# EasyEDA Pro project Athena.eprj, schematic Schematic, sheet 2 of 4

## Sheets
2 Power: Page Name: Power
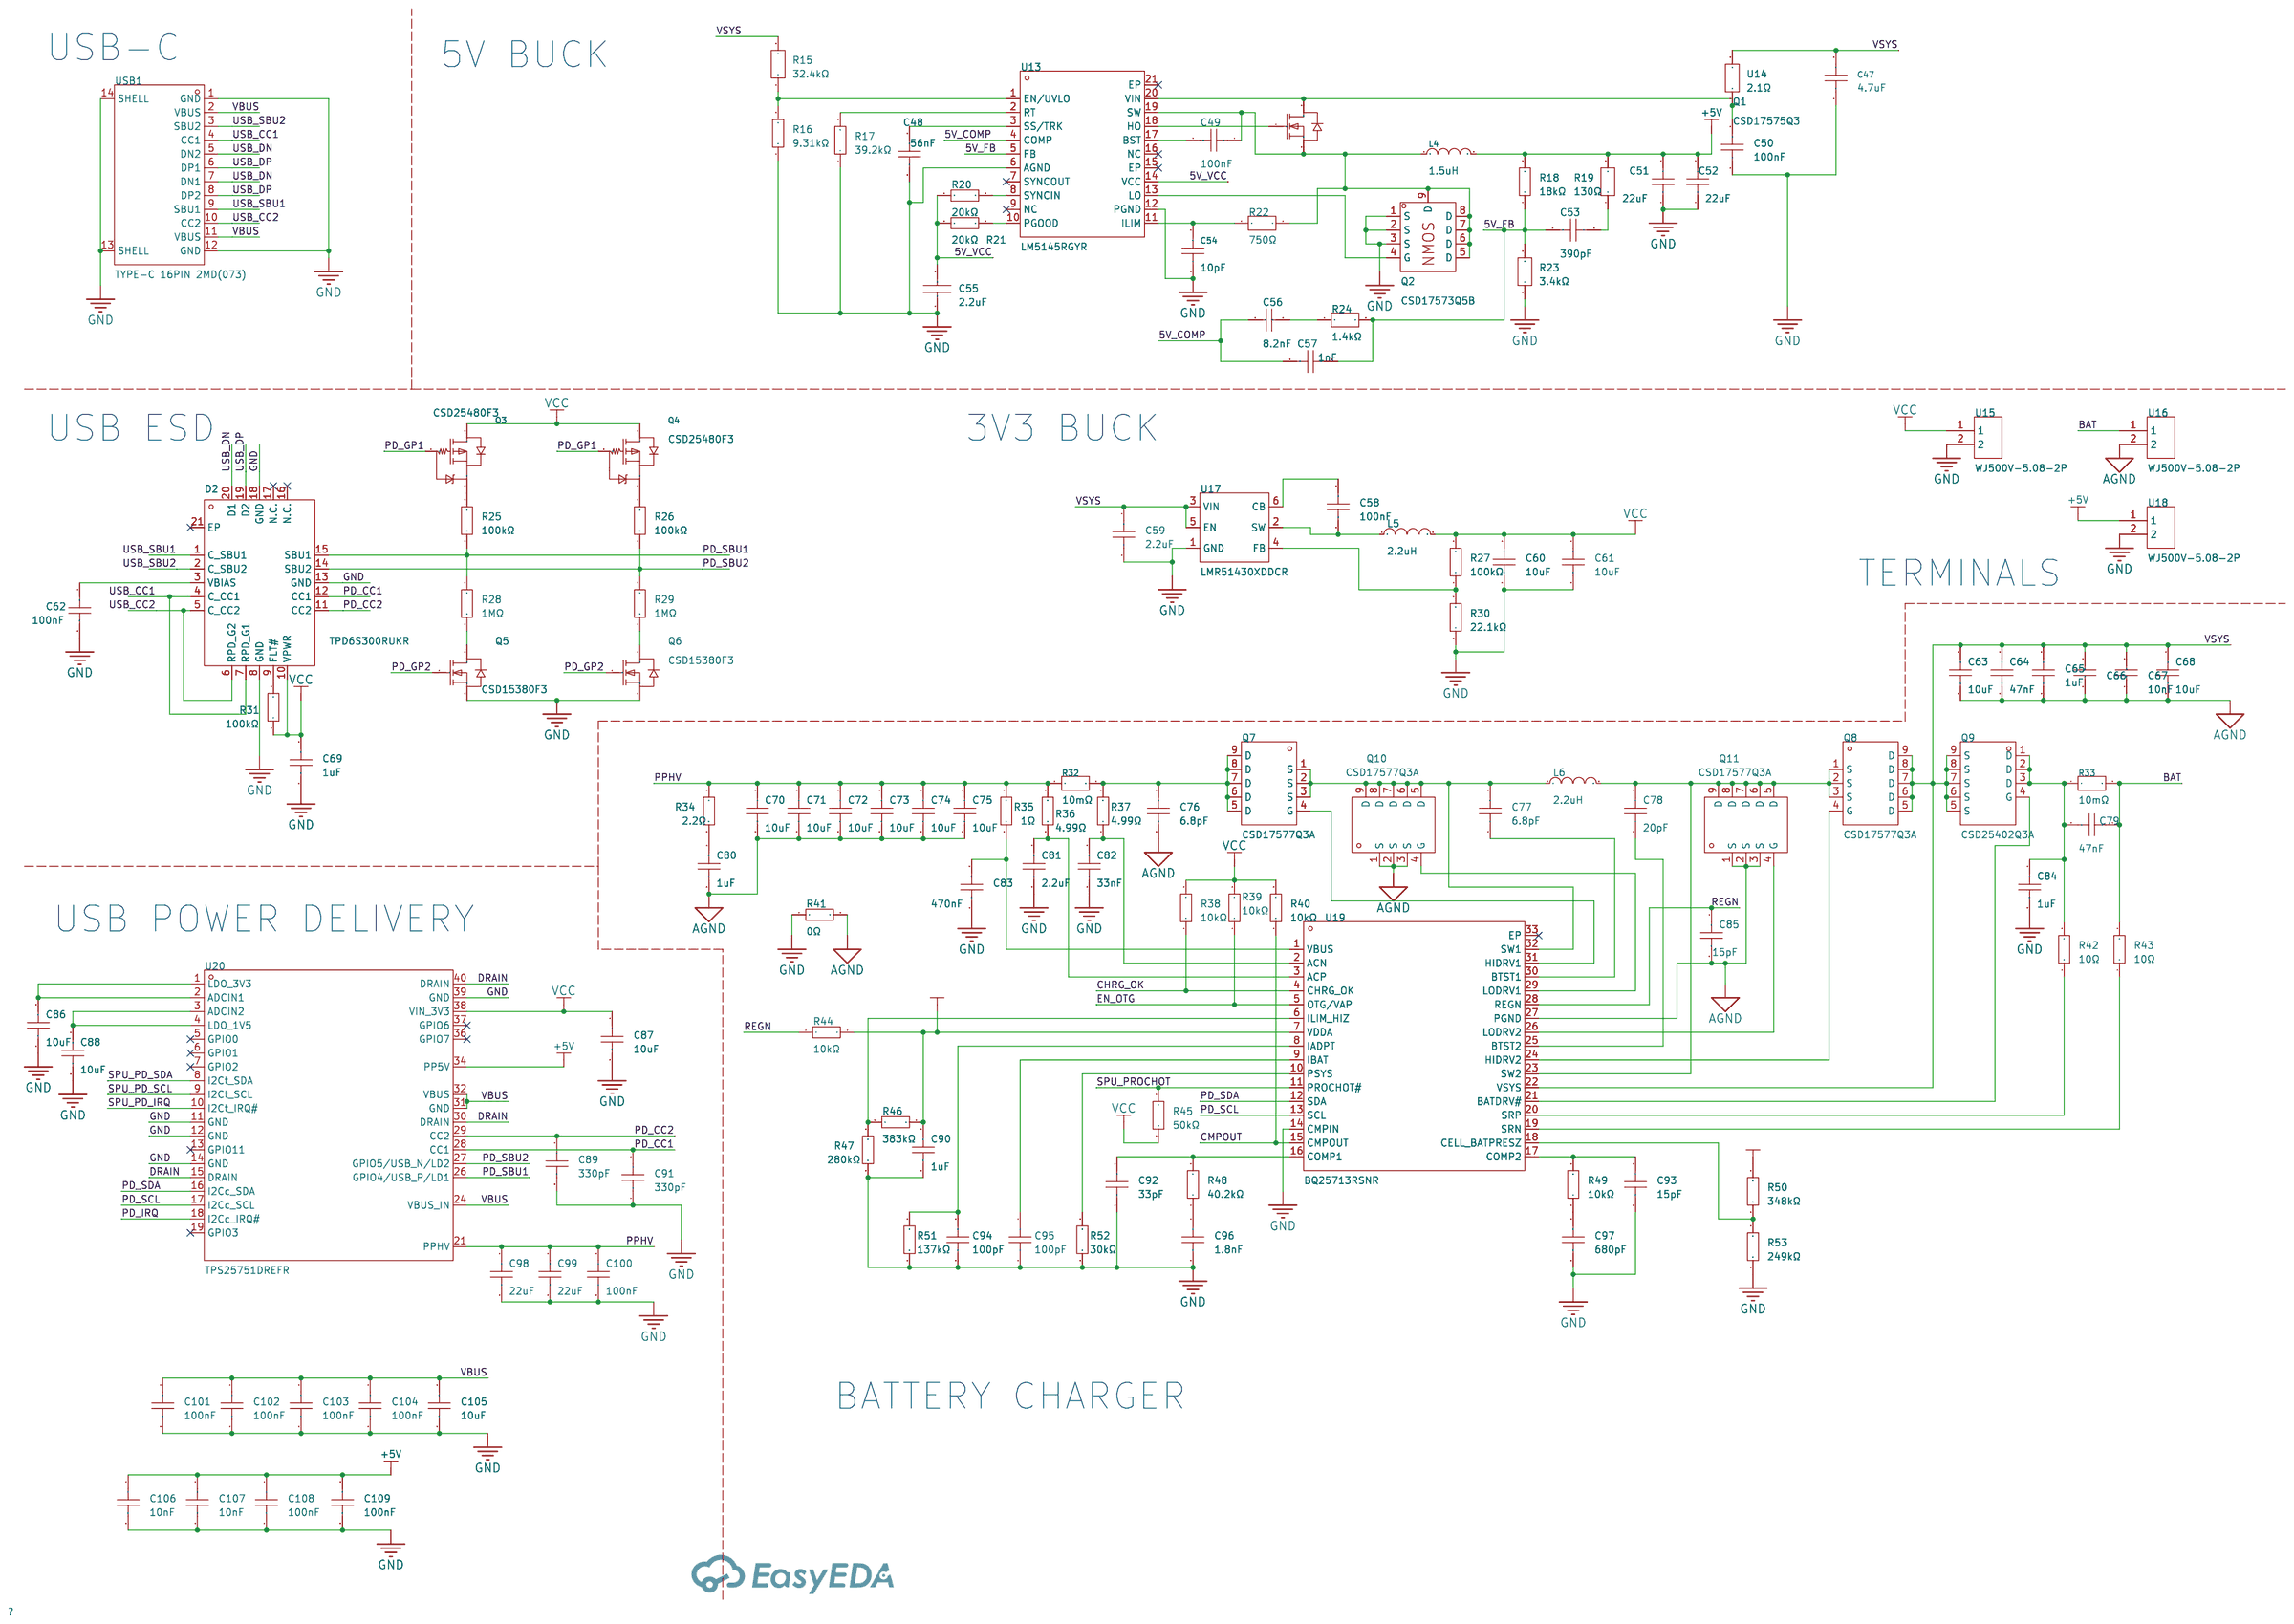
[diagram p1: Power]

## Parts
C47  4.7uF  [C1210]
C48  56nF  [C0603]
C49  100nF  [C0603]
C50  100nF  [C0603]
C51  22uF  [C0805]
C52  22uF  [C0805]
C53  390pF  [C0402]
C54  10pF  [C0603]
C55  2.2uF  [C0402]
C56  8.2nF  [C0402]
C57  1nF  [C0402]
C58  100nF  [C0402]
C59  2.2uF  [C0805]
C60  10uF  [C0603]
C61  10uF  [C0603]
C62  100nF  [C0402]
C63  10uF  [C0805]
C64  47nF  [C0805]
C65  1uF  [C0805]
C66  100pF  [C0805]
C67  10nF  [C0805]
C68  10uF  [C0805]
C69  1uF  [C0402]
C70  10uF  [C0805]
C71  10uF  [C0805]
C72  10uF  [C0805]
C73  10uF  [C0805]
C74  10uF  [C0805]
C75  10uF  [C0805]
C76  6.8pF  [C0603]
C77  6.8pF  [C0603]
C78  20pF  [C0603]
C79  47nF  [C0402]
C80  1uF  [C0402]
C81  2.2uF  [C0603]
C82  33nF  [C0603]
C83  470nF  [C0603]
C84  1uF  [C0402]
C85  15pF  [C0402]
C86  10uF  [C0402]
C87  10uF  [C0402]
C88  10uF  [C0402]
C89  330pF  [C0402]
C90  1uF  [C0402]
C91  330pF  [C0402]
C92  33pF  [C0402]
C93  15pF  [C0402]
C94  100pF  [C0402]
C95  100pF  [C0402]
C96  1.8nF  [C0402]
C97  680pF  [C0402]
C98  22uF  [C0805]
C99  22uF  [C0805]
C100  100nF  [C0402]
C101  100nF  [C0402]
C102  100nF  [C0402]
C103  100nF  [C0402]
C104  100nF  [C0402]
C105  10uF  [C0805]
C106  10nF  [C0402]
C107  10nF  [C0402]
C108  100nF  [C0805]
C109  100nF  [C0805]
D2  TPD6S300RUKR  [WQFN-20_L3.0-W3.0-P0.40-BL-EP1.7]
L4  1.5uH  [IND-SMD_L11.5-W10.0_104CDMCCDS]
L5  2.2uH  [L1206]
L6  2.2uH  [IND-SMD_L4.4-W4.2]
Q1  CSD17575Q3  [VSON-CLIP-8_L3.3-W3.3-P0.65-BL]
Q2  CSD17573Q5B  [POWERVDFN-8_L6.0-W5.0-P1.27-BL]
Q3  CSD25480F3  [PICOSTAR-3_L0.7-W0.6-P0.40-TL]
Q4  CSD25480F3  [PICOSTAR-3_L0.7-W0.6-P0.40-TL]
Q5  CSD15380F3  [PICOSTAR-3_L0.7-W0.6-P0.35-TL]
Q6  CSD15380F3  [PICOSTAR-3_L0.7-W0.6-P0.35-TL]
Q7  CSD17577Q3A  [VSONP-8_L3.1-W3.1-P0.65-LS3.5-BL]
Q8  CSD17577Q3A  [VSONP-8_L3.1-W3.1-P0.65-LS3.5-BL]
Q9  CSD25402Q3A  [VSONP-8_L3.1-W3.1-P0.65-LS3.5-BL]
Q10  CSD17577Q3A  [VSONP-8_L3.1-W3.1-P0.65-LS3.5-BL]
Q11  CSD17577Q3A  [VSONP-8_L3.1-W3.1-P0.65-LS3.5-BL]
R15  32.4kΩ  [R0603]
R16  9.31kΩ  [R0603]
R17  39.2kΩ  [R0402]
R18  18kΩ  [R0603]
R19  130Ω  [R0402]
R20  20kΩ  [R0603]
R21  20kΩ  [R0603]
R22  750Ω  [R0402]
R23  3.4kΩ  [R0402]
R24  1.4kΩ  [R0603]
R25  100kΩ  [R0402]
R26  100kΩ  [R0402]
R27  100kΩ  [R0402]
R28  1MΩ  [R0402]
R29  1MΩ  [R0402]
R30  22.1kΩ  [R0402]
R31  100kΩ  [R0402]
R32  10mΩ  [R1206]
R33  10mΩ  [R1206]
R34  2.2Ω  [R0402]
R35  1Ω  [R0402]
R36  4.99Ω  [R0402]
R37  4.99Ω  [R0402]
R38  10kΩ  [R0402]
R39  10kΩ  [R0402]
R40  10kΩ  [R0402]
R41  0Ω  [R0402]
R42  10Ω  [R0402]
R43  10Ω  [R0402]
R44  10kΩ  [R0402]
R45  50kΩ  [R0402]
R46  383kΩ  [R0402]
R47  280kΩ  [R0402]
R48  40.2kΩ  [R0402]
R49  10kΩ  [R0402]
R50  348kΩ  [R0402]
R51  137kΩ  [R0402]
R52  30kΩ  [R0402]
R53  249kΩ  [R0402]
U13  LM5145RGYR  [VQFN-20_L4.5-W3.5-P0.50-BL-EP]
U14  2.1Ω  [R0603]
U15  WJ500V-5.08-2P  [CONN-TH_2P-P5.00_WJ500V-5.08-2P]
U16  WJ500V-5.08-2P  [CONN-TH_2P-P5.00_WJ500V-5.08-2P]
U17  LMR51430XDDCR  [SOT-23-6_L2.9-W1.6-P0.95-LS2.8-BL]
U18  WJ500V-5.08-2P  [CONN-TH_2P-P5.00_WJ500V-5.08-2P]
U19  BQ25713RSNR  [QFN-32_L4.0-W4.0-P0.40-TL-EP2.8]
U20  TPS25751DREFR  [QFN-38_L6.0-W4.0-P0.40-TL-EP_TI_REF0038A]
USB1  TYPE-C 16PIN 2MD(073)  [USB-C-SMD_TYPE-C-6PIN-2MD-073]

## Library data of the parts
C47 = GRM32ER71H475KA88L: LCSC Part Name: 4.7uF ±10% 50V; Supplier Part: C86052; Manufacturer: muRata(村田); Supplier Footprint: 1210; JLCPCB Part Class: Extended Part; Datasheet: https://atta.szlcsc.com/upload/public/pdf/source/20200305/C490387_23319AE8C154DEB24C505E6C82A8106A.pdf; Supplier: LCSC; Tolerance: ±10%
C48 = CC0603KRX7R9BB563: LCSC Part Name: 56nF ±10% 50V; Supplier Part: C282072; Manufacturer: YAGEO(国巨); Supplier Footprint: 0603; JLCPCB Part Class: Extended Part; Datasheet: https://atta.szlcsc.com/upload/public/pdf/source/20180910/C282072_33301C7F631E79921B82A8DAC6BCC5B3.pdf; Supplier: LCSC; Tolerance: ±10%
C49 C50 = CC0603KRX7R9BB104: LCSC Part Name: 100nF ±10% 50V; Supplier Part: C14663; Manufacturer: YAGEO(国巨); Supplier Footprint: 0603; JLCPCB Part Class: Basic Part; Datasheet: https://atta.szlcsc.com/upload/public/pdf/source/20250214/096C4C206003071F5D32E5F0D8E7F8DF.pdf; Supplier: LCSC; Tolerance: ±10%; Voltage Rating: 50V; Temperature Coefficient: X7R
C51 C52 = CL21A226MAYNNNE: LCSC Part Name: 22uF ±20% 25V; Supplier Part: C602037; Manufacturer: SAMSUNG(三星); Supplier Footprint: 0805; JLCPCB Part Class: Extended Part; Datasheet: https://item.szlcsc.com/datasheet/CL21A226MAYNNNE/631473.html; Supplier: LCSC; Tolerance: ±20%; Voltage Rating: 25V; Temperature Coefficient: X5R
C53 = GRM155R71H391KA01D: LCSC Part Name: 390pF ±10% 50V NRND物料(将要停产) 原厂不接订单; Supplier Part: C185563; Manufacturer: muRata(村田); Supplier Footprint: 0402; JLCPCB Part Class: Extended Part; Datasheet: https://atta.szlcsc.com/upload/public/pdf/source/20190725/C185563_90001B6F14E9F7B861ADEBE8CCB1D839.pdf; Supplier: LCSC; Tolerance: ±10%
C54 = CC0603JRNPO0BN100: LCSC Part Name: 10pF ±5% 100V; Supplier Part: C576799; Manufacturer: YAGEO(国巨); Supplier Footprint: 0603; JLCPCB Part Class: Extended Part; Datasheet: https://atta.szlcsc.com/upload/public/pdf/source/20200814/C576799_FFC052976BB908963E8862AC2CBE779D.pdf; Supplier: LCSC; Tolerance: ±5%
C55 = CL05A225MQ5NSNC: LCSC Part Name: 2.2uF ±20% 6.3V; Supplier Part: C12530; Manufacturer: SAMSUNG(三星); Supplier Footprint: 0402; JLCPCB Part Class: Basic Part; Datasheet: https://item.szlcsc.com/datasheet/CL05A225MQ5NSNC/13164.html; Supplier: LCSC; Tolerance: ±20%; Voltage Rating: 6.3V; Temperature Coefficient: X5R
C56 = CC0402KRX7R9BB822: LCSC Part Name: 8.2nF ±10% 50V; Supplier Part: C107032; Manufacturer: YAGEO(国巨); Supplier Footprint: 0402; JLCPCB Part Class: Extended Part; Datasheet: https://atta.szlcsc.com/upload/public/pdf/source/20170914/C128857_1505359892143968080.pdf; Supplier: LCSC; Tolerance: ±10%
C57 = TCC0402X7R102M500AT: LCSC Part Name: 1nF ±20% 50V; Supplier Part: C696907; Manufacturer: CCTC(三环); Supplier Footprint: 0402; JLCPCB Part Class: Extended Part; Datasheet: https://atta.szlcsc.com/upload/public/pdf/source/20200707/C696841_89A2C111301AB76AE7642008585E7A11.pdf; Supplier: LCSC; Tolerance: ±20%; Voltage Rating: 50V; Temperature Coefficient: X7R
C58 C62 C100-C104 = GRM155R71H104KE14D: LCSC Part Name: 100nF ±10% 50V; Supplier Part: C77020; Manufacturer: muRata(村田); Supplier Footprint: 0402; JLCPCB Part Class: Extended Part; Datasheet: https://atta.szlcsc.com/upload/public/pdf/source/20180326/C77020_39BD49C951FF1AF0DB1F1FAC5AC1E401.pdf; Supplier: LCSC; Tolerance: ±10%; Standardization Check: false
C59 = CL21A225KBQNNNE: LCSC Part Name: 2.2uF ±10% 50V; Supplier Part: C377773; Manufacturer: SAMSUNG(三星); Supplier Footprint: 0805; JLCPCB Part Class: Basic Part; Datasheet: https://item.szlcsc.com/datasheet/CL21A225KBQNNNE/350246.html; Supplier: LCSC; Tolerance: ±10%; Voltage Rating: 50V; Temperature Coefficient: X5R; Standardization Check: false
C60 C61 = CL10A106MA8NRNC: LCSC Part Name: 10uF ±20% 25V; Supplier Part: C96446; Manufacturer: SAMSUNG(三星); Supplier Footprint: 0603; JLCPCB Part Class: Basic Part; Datasheet: https://item.szlcsc.com/datasheet/CL10A106MA8NRNC/97651.html; Supplier: LCSC; Tolerance: ±20%; Voltage Rating: 25V; Temperature Coefficient: X5R; Standardization Check: false
C63 C68 C70-C75 = GRM21BR61H106KE43L: LCSC Part Name: 10uF ±10% 50V; Supplier Part: C440198; Manufacturer: muRata(村田); Supplier Footprint: 0805; JLCPCB Part Class: Basic Part; Datasheet: https://atta.szlcsc.com/upload/public/pdf/source/20230811/95AAE0C9AF55EDC31B7A4D8B733F534E.pdf; Supplier: LCSC; Tolerance: ±10%; Standardization Check: false
C64 = CL21B473KBCNNNC: Capacitance: Tolerance:±10% Tolerance:±10% Voltage Rated: Temperature Coefficient:; LCSC Part Name: 47nF ±10% 50V; Supplier Part: C53134; Manufacturer: SAMSUNG(三星); Supplier Footprint: 0805; JLCPCB Part Class: Basic Part; Datasheet: https://atta.szlcsc.com/upload/public/pdf/source/20160218/1457707763339.pdf; Supplier: LCSC; Tolerance: ±10%
C65 = CL21B105KBFNNNE: Capacitance:1uF Tolerance:±10% Tolerance:±10% Voltage Rating:50V Temperature Coefficient:X7R; LCSC Part Name: 1uF ±10% 50V; Supplier Part: C28323; Manufacturer: SAMSUNG(三星); Supplier Footprint: 0805; JLCPCB Part Class: Basic Part; Datasheet: https://item.szlcsc.com/datasheet/CL21B105KBFNNNE/29074.html; Supplier: LCSC; Tolerance: ±10%; Voltage Rating: 50V; Temperature Coefficient: X7R
C66 = CL21C101JBANNNC: Capacitance:100pF Tolerance:±5% Tolerance:±5% Voltage Rating:50V Temperature Coefficient:C0G; LCSC Part Name: 100pF ±5% 50V; Supplier Part: C1790; Manufacturer: SAMSUNG(三星); Supplier Footprint: 0805; JLCPCB Part Class: Basic Part; Datasheet: https://item.szlcsc.com/datasheet/CL21C101JBANNNC/2142.html; Supplier: LCSC; Tolerance: ±5%; Voltage Rating: 50V; Temperature Coefficient: C0G
C67 = CL21B103KBANNNC: Capacitance:10nF Tolerance:±10% Tolerance:±10% Voltage Rating:50V Temperature Coefficient:X7R; LCSC Part Name: 10nF ±10% 50V; Supplier Part: C1710; Manufacturer: SAMSUNG(三星); Supplier Footprint: 0805; JLCPCB Part Class: Basic Part; Datasheet: https://item.szlcsc.com/datasheet/CL21B103KBANNNC/2062.html; Supplier: LCSC; Tolerance: ±10%; Voltage Rating: 50V; Temperature Coefficient: X7R
C69 C80 C84 C90 = CL05A105KA5NQNC: LCSC Part Name: 1uF ±10% 25V; Supplier Part: C52923; Manufacturer: SAMSUNG(三星); Supplier Footprint: 0402; JLCPCB Part Class: Basic Part; Datasheet: https://item.szlcsc.com/datasheet/CL05A105KA5NQNC/53938.html; Supplier: LCSC; Tolerance: ±10%; Voltage Rating: 25V; Temperature Coefficient: X5R; Standardization Check: false
C76 C77 = CC0603CRNPO9BN6R8: Capacitance:6.8pF Voltage Rating:50V Temperature Coefficient:NP0; LCSC Part Name: ±0.25pF 6.8pF 50V; Supplier Part: C282251; Manufacturer: YAGEO(国巨); Supplier Footprint: 0603; JLCPCB Part Class: Extended Part; Datasheet: https://item.szlcsc.com/datasheet/CC0603CRNPO9BN6R8/268271.html; Supplier: LCSC; Voltage Rating: 50V; Temperature Coefficient: NP0
C78 = CC0603JRNPO9BN200: Capacitance: Tolerance:±5% Tolerance:±5% Voltage Rated: Temperature Coefficient:; LCSC Part Name: 20pF ±5% 50V; Supplier Part: C105621; Manufacturer: YAGEO(国巨); Supplier Footprint: 0603; JLCPCB Part Class: Extended Part; Datasheet: https://atta.szlcsc.com/upload/public/pdf/source/20170505/1493957838062.pdf; Supplier: LCSC; Tolerance: ±5%
C79 = CC0402KRX7R9BB473: LCSC Part Name: 47nF ±10% 50V; Supplier Part: C272875; Manufacturer: YAGEO(国巨); Supplier Footprint: 0402; JLCPCB Part Class: Extended Part; Datasheet: https://item.szlcsc.com/datasheet/CC0402KRX7R9BB473/261267.html; Supplier: LCSC; Tolerance: ±10%; Voltage Rating: 50V; Temperature Coefficient: X7R; Standardization Check: false
C81 = CL10A225KB8NNNC: Capacitance:2.2uF Tolerance:±10% Tolerance:±10% Voltage Rating:50V Temperature Coefficient:X5R; LCSC Part Name: 2.2uF ±10% 50V; Supplier Part: C913904; Manufacturer: SAMSUNG(三星); Supplier Footprint: 0603; JLCPCB Part Class: Extended Part; Datasheet: https://item.szlcsc.com/datasheet/CL10A225KB8NNNC/984470.html; Supplier: LCSC; Tolerance: ±10%; Voltage Rating: 50V; Temperature Coefficient: X5R
C82 = CL10B333KB8NNNC: LCSC Part Name: 33nF ±10% 50V; Supplier Part: C21117; Manufacturer: SAMSUNG(三星); Supplier Footprint: 0603; JLCPCB Part Class: Basic Part; Datasheet: https://item.szlcsc.com/datasheet/CL10B333KB8NNNC/21829.html; Supplier: LCSC; Tolerance: ±10%; Voltage Rating: 50V; Temperature Coefficient: X7R; Standardization Check: false
C83 = CC0603KRX7R9BB474: LCSC Part Name: 470nF ±10% 50V; Supplier Part: C513577; Manufacturer: YAGEO(国巨); Supplier Footprint: 0603; JLCPCB Part Class: Extended Part; Datasheet: https://item.szlcsc.com/datasheet/CC0603KRX7R9BB474/528404.html; Supplier: LCSC; Tolerance: ±10%; Voltage Rating: 50V; Temperature Coefficient: X7R; Standardization Check: false
C85 C93 = 0402CG150J500NT: LCSC Part Name: 15pF ±5% 50V; Supplier Part: C1548; Manufacturer: FH(风华); Supplier Footprint: 0402; JLCPCB Part Class: Basic Part; Datasheet: https://item.szlcsc.com/datasheet/0402CG150J500NT/1900.html; Supplier: LCSC; Tolerance: ±5%; Voltage Rating: 50V; Temperature Coefficient: C0G; Standardization Check: false
C86-C88 = CL05A106MP5NUNC_C315248: LCSC Part Name: 10uF ±20% 10V; Supplier Part: C315248; Manufacturer: SAMSUNG(三星); Manufacturer Part: CL05A106MP5NUNC; Supplier Footprint: 0402; JLCPCB Part Class: Extended Part; Datasheet: https://item.szlcsc.com/datasheet/CL05A106MP5NUNC/297154.html; Supplier: LCSC; Tolerance: ±20%; Voltage Rating: 10V; Temperature Coefficient: X5R; Standardization Check: false
C89 C91 = CC0402KRX7R9BB331: LCSC Part Name: 330pF ±10% 50V; Supplier Part: C106206; Manufacturer: YAGEO(国巨); Supplier Footprint: 0402; JLCPCB Part Class: Extended Part; Datasheet: https://item.szlcsc.com/datasheet/CC0402KRX7R9BB331/107421.html; Supplier: LCSC; Tolerance: ±10%; Voltage Rating: 50V; Temperature Coefficient: X7R; Standardization Check: false
C92 = CC0402JRNPO9BN330: LCSC Part Name: 33pF ±5% 50V; Supplier Part: C107005; Manufacturer: YAGEO(国巨); Supplier Footprint: 0402; JLCPCB Part Class: Extended Part; Datasheet: https://atta.szlcsc.com/upload/public/pdf/source/20181008/C309499_21CC21451B82C39E3D92150FD6B30293.pdf; Supplier: LCSC; Tolerance: ±5%; Standardization Check: false
C94 C95 = 0402CG101J500NT: LCSC Part Name: 100pF ±5% 50V; Supplier Part: C1546; Manufacturer: FH(风华); Supplier Footprint: 0402; JLCPCB Part Class: Basic Part; Datasheet: https://atta.szlcsc.com/upload/public/pdf/source/20200305/C486355_26A10D38EF8C2A5C37091D0039909270.pdf; Supplier: LCSC; Tolerance: ±5%; Standardization Check: false
C96 = CC0402JRX7R9BB182: LCSC Part Name: 1.8nF ±5% 50V; Supplier Part: C527007; Manufacturer: YAGEO(国巨); Supplier Footprint: 0402; JLCPCB Part Class: Extended Part; Datasheet: https://item.szlcsc.com/datasheet/CC0402JRX7R9BB182/545433.html; Supplier: LCSC; Tolerance: ±5%; Voltage Rating: 50V; Temperature Coefficient: X7R; Standardization Check: false
C97 = CC0402KRX7R9BB681: LCSC Part Name: 680pF ±10% 50V; Supplier Part: C107030; Manufacturer: YAGEO(国巨); Supplier Footprint: 0402; JLCPCB Part Class: Extended Part; Datasheet: https://item.szlcsc.com/datasheet/CC0402KRX7R9BB681/108246.html; Supplier: LCSC; Tolerance: ±10%; Voltage Rating: 50V; Temperature Coefficient: X7R; Standardization Check: false
C98 C99 = CL21A226MAQNNNE: LCSC Part Name: 22uF ±20% 25V; Supplier Part: C45783; Manufacturer: SAMSUNG(三星); Supplier Footprint: 0805; JLCPCB Part Class: Basic Part; Datasheet: https://item.szlcsc.com/datasheet/CL21A226MAQNNNE/46786.html; Supplier: LCSC; Tolerance: ±20%; Voltage Rating: 25V; Temperature Coefficient: X5R; Standardization Check: false
C105 = GRM21BR61H106KE43L: Capacitance: Tolerance:±10% Tolerance:±10% Voltage Rated: Temperature Coefficient:; LCSC Part Name: 10uF ±10% 50V; Supplier Part: C440198; Manufacturer: muRata(村田); Supplier Footprint: 0805; JLCPCB Part Class: Basic Part; Datasheet: https://atta.szlcsc.com/upload/public/pdf/source/20230811/95AAE0C9AF55EDC31B7A4D8B733F534E.pdf; Supplier: LCSC; Tolerance: ±10%
C106 C107 = CL05B103KB5NNNC: LCSC Part Name: 10nF ±10% 50V; Supplier Part: C15195; Manufacturer: SAMSUNG(三星); Supplier Footprint: 0402; JLCPCB Part Class: Basic Part; Datasheet: https://item.szlcsc.com/datasheet/CL05B103KB5NNNC/15869.html; Supplier: LCSC; Tolerance: ±10%; Voltage Rating: 50V; Temperature Coefficient: X7R; Standardization Check: false
C108 C109 = CC0805KRX7R9BB104: LCSC Part Name: 100nF ±10% 50V; Supplier Part: C49678; Manufacturer: YAGEO(国巨); Supplier Footprint: 0805; JLCPCB Part Class: Basic Part; Datasheet: https://item.szlcsc.com/datasheet/CC0805KRX7R9BB104/50686.html; Supplier: LCSC; Tolerance: ±10%; Voltage Rating: 50V; Temperature Coefficient: X7R; Standardization Check: false
D2 = TPD6S300RUKR: Supplier Part: C2649810; Manufacturer: TI(德州仪器); Supplier Footprint: WQFN-20-EP(3x3); JLCPCB Part Class: Extended Part; Datasheet: https://www.ti.com/cn/lit/gpn/tpd6s300; Supplier: LCSC
L4 = 104CDMCCDS-1R5MC: LCSC Part Name: 1.5uH ±20% 29A; Supplier Part: C516064; Manufacturer: Sumida(胜美达); Supplier Footprint: SMD,11.5x10mm; JLCPCB Part Class: Extended Part; Datasheet: https://atta.szlcsc.com/upload/public/pdf/source/20180125/C167296_15168662824641303024.pdf; Supplier: LCSC; Tolerance: ±20%; Saturation Current (Isat): 29A
L5 = CMP321609UD2R2MT: LCSC Part Name: 2.2uH ±20%; Supplier Part: C139249; Manufacturer: FH(风华); Supplier Footprint: 1206; JLCPCB Part Class: Extended Part; Datasheet: https://atta.szlcsc.com/upload/public/pdf/source/20230223/9514AABD49028510480EFFDFC3336E06.pdf; Supplier: LCSC; Tolerance: ±20%; Standardization Check: false
L6 = FXL0420-2R2-M: LCSC Part Name: 2.2uH ±20% 5A; Supplier Part: C167206; Manufacturer: cjiang(长江微电); Supplier Footprint: SMD,4.2x4.4mm; JLCPCB Part Class: Extended Part; Datasheet: https://atta.szlcsc.com/upload/public/pdf/source/20250421/DC75C633ACB13F952A25DE8912719752.pdf; Supplier: LCSC; Tolerance: ±20%; Current Rating: 4.5A; Current - Saturation(Isat): 5A; DC Resistance(DCR): 58mΩ; Type: Molded Inductor
Q1 = CSD17575Q3: LCSC Part Name: 1个N沟道 耐压:30V 电流:60A; Supplier Part: C529277; Manufacturer: TI(德州仪器); Supplier Footprint: VSON-CLIP-8(3.3x3.3); JLCPCB Part Class: Extended Part; Datasheet: https://www.ti.com/cn/lit/gpn/csd17575q3; Supplier: LCSC; Number: 1 N-Channel; Drain to Source Voltage: 30V; Current - Continuous Drain(Id): 60A; RDS(on): 1.9mΩ@10V,25A; Pd - Power Dissipation: 2.8W; Gate Threshold Voltage (Vgs(th)): 1.4V; Gate Charge(Qg): 23nC@4.5V; Input Capacitance(Ciss): 4.42nF; Reverse Transfer Capacitance (Crss@Vds): 204pF; Operating Temperature: -55℃~+150℃
Q2 = CSD17573Q5B: LCSC Part Name: 1个N沟道 耐压:30V 电流:100A; Supplier Part: C202231; Manufacturer: TI(德州仪器); Supplier Footprint: PDFN-8(5x6); JLCPCB Part Class: Extended Part; Datasheet: https://www.ti.com/cn/lit/gpn/csd17573q5b; Supplier: LCSC; Type: 1 N-Channel; Drain Source On Resistance (RDS(on)@Vgs,Id): 1mΩ@10V,35A; Gate Threshold Voltage (Vgs(th)@Id): 1.4V@250uA; Total Gate Charge (Qg@Vgs): 49nC@4.5V; Input Capacitance (Ciss@Vds): 6920pF; Reverse Transfer Capacitance (Crss@Vds): 390pF; Operating Temperature: -55℃~+150℃
Q3 Q4 = CSD25480F3: LCSC Part Name: P沟道 耐压:20V 电流:1.7A; Supplier Part: C2869359; Manufacturer: TI(德州仪器); Supplier Footprint: PicoStar-3; JLCPCB Part Class: Extended Part; Datasheet: https://www.ti.com/cn/lit/gpn/csd25480f3; Supplier: LCSC; Drain Source Voltage (Vdss): 20V; Drain Source On Resistance (RDS(on)@Vgs,Id): 132mΩ@400mA,8V; Gate Threshold Voltage (Vgs(th)@Id): 1.2V@250uA; Total Gate Charge (Qg@Vgs): 910pC@4.5V; Input Capacitance (Ciss@Vds): 155pF@10V; Operating Temperature: -55℃~+150℃@(Tj)
Q5 Q6 = CSD15380F3: LCSC Part Name: 1个N沟道 耐压:20V 电流:500mA; Supplier Part: C529568; Manufacturer: TI(德州仪器); Supplier Footprint: LGA; JLCPCB Part Class: Extended Part; Datasheet: https://www.ti.com/cn/lit/gpn/csd15380f3; Supplier: LCSC; Type: 1 N-Channel; Drain Source Voltage (Vdss): 20V; Continuous Drain Current (Id): 500mA; Drain Source On Resistance (RDS(on)@Vgs,Id): 990mΩ@8V,0.1A; Gate Threshold Voltage (Vgs(th)@Id): 1.1V@2.5uA; Total Gate Charge (Qg@Vgs): 0.281nC@4.5V; Input Capacitance (Ciss@Vds): 10.5pF@10V; Reverse Transfer Capacitance (Crss@Vds): 0.17pF@10V; Operating Temperature: -55℃~+150℃
Q7 Q8 Q10 Q11 = CSD17577Q3A: LCSC Part Name: 1个N沟道 耐压:30V 电流:35A; Supplier Part: C201632; Manufacturer: TI(德州仪器); Supplier Footprint: VSONP-8(3.3x3.3); JLCPCB Part Class: Extended Part; Datasheet: https://www.ti.com/cn/lit/gpn/csd17577q3a; Supplier: LCSC; Type: 1 N-Channel; Drain Source On Resistance (RDS(on)@Vgs,Id): 5.3mΩ@4.5V,10A; Gate Threshold Voltage (Vgs(th)@Id): 1.4V@250uA; Total Gate Charge (Qg@Vgs): 17nC@4.5V; Input Capacitance (Ciss@Vds): 2.31nF; Reverse Transfer Capacitance (Crss@Vds): 103pF; Operating Temperature: -40℃~+85℃
Q9 = CSD25402Q3A: LCSC Part Name: 1个P沟道 耐压:20V 电流:72A; Supplier Part: C111356; Manufacturer: TI(德州仪器); Supplier Footprint: VSONP-8(3.3x3.3); JLCPCB Part Class: Extended Part; Datasheet: https://www.ti.com/cn/lit/gpn/csd25402q3a; Supplier: LCSC; Number: 1 P-Channel; Drain to Source Voltage: 20V; Current - Continuous Drain(Id): 72A; RDS(on): 74mΩ@1.8V,1A; Pd - Power Dissipation: 2.8W; Gate Threshold Voltage (Vgs(th)): 1.15V@250uA; Gate Charge(Qg): 7.5nC@4.5V; Operating Temperature: -55℃~+150℃; Type: P-Channel
R15 = FRC0603F3242TS: LCSC Part Name: 32.4kΩ ±1% 100mW 厚膜电阻; Supplier Part: C2998122; Manufacturer: FOJAN(富捷); Supplier Footprint: 0603; JLCPCB Part Class: Extended Part; Datasheet: https://item.szlcsc.com/datasheet/FRC0603F3242TS/3471480.html; Supplier: LCSC; Type: Thick Film Resistor; Tolerance: ±1%; Power(Watts): 100mW; Voltage-Supply(Max): 75V; Temperature Coefficient: ±100ppm/℃; Operating Temperature: -55℃~+155℃
R16 = RC0603FR-079K31L: LCSC Part Name: 厚膜电阻 9.31kΩ ±1% 100mW; Supplier Part: C137666; Manufacturer: YAGEO(国巨); Supplier Footprint: 0603; JLCPCB Part Class: Extended Part; Datasheet: https://atta.szlcsc.com/upload/public/pdf/source/20180821/C275644_0D56F95EFF785E7D9A1FEF436B37DA78.pdf; Supplier: LCSC; Type: Thick Film Resistors; Tolerance: ±1%; Temperature Coefficient: ±100ppm/℃; Operating Temperature Range: -55℃~+155℃
R17 = RC0402FR-0739K2L: LCSC Part Name: 厚膜电阻 39.2kΩ ±1% 62.5mW; Supplier Part: C137996; Manufacturer: YAGEO(国巨); Supplier Footprint: 0402; JLCPCB Part Class: Extended Part; Datasheet: https://item.szlcsc.com/datasheet/RC0402FR-0739K2L/149312.html; Supplier: LCSC; Type: Thick Film Resistor; Tolerance: ±1%; Power(Watts): 62.5mW; Voltage-Supply(Max): 50V; Temperature Coefficient: ±100ppm/℃; Operating Temperature: -55℃~+155℃
R18 = RC0603FR-0718KL: LCSC Part Name: 厚膜电阻 18kΩ ±1% 100mW; Supplier Part: C114610; Manufacturer: YAGEO(国巨); Supplier Footprint: 0603; JLCPCB Part Class: Extended Part; Datasheet: https://atta.szlcsc.com/upload/public/pdf/source/20180821/C275644_0D56F95EFF785E7D9A1FEF436B37DA78.pdf; Supplier: LCSC; Type: Thick Film Resistors; Tolerance: ±1%; Temperature Coefficient: ±100ppm/℃; Operating Temperature Range: -55℃~+155℃
R19 = RC0402FR-07130RL: LCSC Part Name: 厚膜电阻 130Ω ±1% 62.5mW; Supplier Part: C477610; Manufacturer: YAGEO(国巨); Supplier Footprint: 0402; JLCPCB Part Class: Extended Part; Datasheet: https://atta.szlcsc.com/upload/public/pdf/source/20200715/C477610_0CD4C9F9B4DD2BDD686CF834934A7A8C.pdf; Supplier: LCSC; Type: Thick Film Resistors; Tolerance: ±1%; Temperature Coefficient: ±100ppm/℃; Operating Temperature Range: -55℃~+155℃
R20 R21 = RC0603FR-0720KL: LCSC Part Name: 厚膜电阻 20kΩ ±1% 100mW; Supplier Part: C105575; Manufacturer: YAGEO(国巨); Supplier Footprint: 0603; JLCPCB Part Class: Extended Part; Datasheet: https://atta.szlcsc.com/upload/public/pdf/source/20180821/C275644_0D56F95EFF785E7D9A1FEF436B37DA78.pdf; Supplier: LCSC; Type: Thick Film Resistors; Tolerance: ±1%; Temperature Coefficient: ±100ppm/℃; Operating Temperature Range: -55℃~+155℃
R22 = CRCW0402750RFKEDC: LCSC Part Name: 厚膜电阻 750Ω ±1% 62.5mW; Supplier Part: C2076735; Manufacturer: VISHAY(威世); Supplier Footprint: 0402; JLCPCB Part Class: Extended Part; Datasheet: https://atta.szlcsc.com/upload/public/pdf/source/20210501/3A8C68602BA6317D7357138250FC3EA2.pdf; Supplier: LCSC; Type: Thick Film Resistors; Tolerance: ±1%; Temperature Coefficient: ±100ppm/℃; Operating Temperature Range: -55℃~+155℃
R23 = CRCW04023K40FKED: LCSC Part Name: 厚膜电阻 3.4kΩ ±1% 62.5mW; Supplier Part: C2085341; Manufacturer: VISHAY(威世); Supplier Footprint: 0402; JLCPCB Part Class: Extended Part; Datasheet: https://atta.szlcsc.com/upload/public/pdf/source/20210503/4CAD3FA9B4C9A749933C1C52DBF827C2.pdf; Supplier: LCSC; Type: Thick Film Resistors; Tolerance: ±1%; Power(Watts): 62.5mW; Voltage-Supply(Max): 75V; Temperature Coefficient: ±100ppm/℃; Operating Temperature: -55℃~+155℃
R24 = FRC0603F1401TS: LCSC Part Name: 1.4kΩ ±1% 100mW 厚膜电阻; Supplier Part: C2930049; Manufacturer: FOJAN(富捷); Supplier Footprint: 0603; JLCPCB Part Class: Extended Part; Datasheet: https://item.szlcsc.com/datasheet/FRC0603F1401TS/3266982.html; Supplier: LCSC; Type: Thick Film Resistor; Tolerance: ±1%; Power(Watts): 100mW; Voltage-Supply(Max): 75V; Temperature Coefficient: ±100ppm/℃; Operating Temperature: -55℃~+155℃
R25-R27 R31 = 0402WGF1003TCE: LCSC Part Name: 100kΩ ±1% 62.5mW 厚膜电阻; Supplier Part: C25741; Manufacturer: UNI-ROYAL(厚声); Supplier Footprint: 0402; JLCPCB Part Class: Basic Part; Datasheet: https://item.szlcsc.com/datasheet/0402WGF1003TCE/26484.html; Supplier: LCSC; Type: Thick Film Resistor; Tolerance: ±1%; Power(Watts): 62.5mW; Voltage-Supply(Max): 50V; Temperature Coefficient: ±100ppm/℃; Operating Temperature: -55℃~+155℃; Standardization Check: false
R28 R29 = 0402WGF1004TCE: LCSC Part Name: 1MΩ ±1% 62.5mW 厚膜电阻; Supplier Part: C26083; Manufacturer: UNI-ROYAL(厚声); Supplier Footprint: 0402; JLCPCB Part Class: Basic Part; Datasheet: https://item.szlcsc.com/datasheet/0402WGF1004TCE/26826.html; Supplier: LCSC; Type: Thick Film Resistor; Tolerance: ±1%; Power(Watts): 62.5mW; Voltage-Supply(Max): 50V; Temperature Coefficient: ±100ppm/℃; Operating Temperature: -55℃~+155℃; Standardization Check: false
R30 = 0402WGF2212TCE: LCSC Part Name: 22.1kΩ ±1% 62.5mW 厚膜电阻; Supplier Part: C43473; Manufacturer: UNI-ROYAL(厚声); Supplier Footprint: 0402; JLCPCB Part Class: Extended Part; Datasheet: https://item.szlcsc.com/datasheet/0402WGF2212TCE/44464.html; Supplier: LCSC; Type: Thick Film Resistor; Tolerance: ±1%; Power(Watts): 62.5mW; Voltage-Supply(Max): 50V; Temperature Coefficient: ±100ppm/℃; Operating Temperature: -55℃~+155℃; Standardization Check: false
R32 R33 = 1206W3F100MT5E: LCSC Part Name: 10mΩ ±1% 333.333mW 厚膜电阻; Supplier Part: C473031; Manufacturer: UNI-ROYAL(厚声); Supplier Footprint: 1206; JLCPCB Part Class: Extended Part; Datasheet: https://item.szlcsc.com/datasheet/1206W3F100MT5E/479801.html; Supplier: LCSC; Type: Thick Film Resistor; Tolerance: ±1%; Power(Watts): 333mW; Voltage-Supply(Max): 200V; Operating Temperature: -55℃~+155℃
R34 = 0402WGF220KTCE: LCSC Part Name: 2.2Ω ±1% 62.5mW 厚膜电阻; Supplier Part: C25101; Manufacturer: UNI-ROYAL(厚声); Supplier Footprint: 0402; JLCPCB Part Class: Extended Part; Datasheet: https://atta.szlcsc.com/upload/public/pdf/source/20200306/C422600_1E6D84923E4A46A82E41ADD87F860B5C.pdf; Supplier: LCSC; Type: Thick Film Resistors; Tolerance: ±1%; Temperature Coefficient: ±200ppm/℃; Operating Temperature Range: -55℃~+155℃; Standardization Check: false
R35 = 0402WGF100KTCE: LCSC Part Name: 1Ω ±1% 62.5mW 厚膜电阻; Supplier Part: C25086; Manufacturer: UNI-ROYAL(厚声); Supplier Footprint: 0402; JLCPCB Part Class: Extended Part; Datasheet: https://item.szlcsc.com/datasheet/0402WGF100KTCE/25829.html; Supplier: LCSC; Type: Thick Film Resistor; Tolerance: ±1%; Power(Watts): 62.5mW; Voltage-Supply(Max): 50V; Temperature Coefficient: ±200ppm/℃; Operating Temperature: -55℃~+155℃; Standardization Check: false
R36 R37 = 0402WGF499KTCE: LCSC Part Name: 4.99Ω ±1% 62.5mW 厚膜电阻; Supplier Part: C25122; Manufacturer: UNI-ROYAL(厚声); Supplier Footprint: 0402; JLCPCB Part Class: Extended Part; Datasheet: https://atta.szlcsc.com/upload/public/pdf/source/20200306/C422600_1E6D84923E4A46A82E41ADD87F860B5C.pdf; Supplier: LCSC; Type: Thick Film Resistors; Tolerance: ±1%; Temperature Coefficient: ±400ppm/℃; Operating Temperature Range: -55℃~+155℃; Standardization Check: false
R38-R40 R44 R49 = 0402WGF1002TCE: LCSC Part Name: 10kΩ ±1% 62.5mW 厚膜电阻; Supplier Part: C25744; Manufacturer: UNI-ROYAL(厚声); Supplier Footprint: 0402; JLCPCB Part Class: Basic Part; Datasheet: https://item.szlcsc.com/datasheet/0402WGF1002TCE/26487.html; Supplier: LCSC; Type: Thick Film Resistor; Tolerance: ±1%; Power(Watts): 62.5mW; Voltage-Supply(Max): 50V; Temperature Coefficient: ±100ppm/℃; Operating Temperature: -55℃~+155℃; Standardization Check: false
R41 = 0402WGF0000TCE: LCSC Part Name: 0Ω ±1% 62.5mW 厚膜电阻; Supplier Part: C17168; Manufacturer: UNI-ROYAL(厚声); Supplier Footprint: 0402; JLCPCB Part Class: Basic Part; Datasheet: https://item.szlcsc.com/datasheet/0402WGF0000TCE/17853.html; Supplier: LCSC; Type: Thick Film Resistor; Tolerance: ±1%; Power(Watts): 62.5mW; Voltage-Supply(Max): 50V; Temperature Coefficient: ±800ppm/℃; Operating Temperature: -55℃~+155℃; Standardization Check: false
R42 R43 = 0402WGF100JTCE: LCSC Part Name: 10Ω ±1% 62.5mW 厚膜电阻; Supplier Part: C25077; Manufacturer: UNI-ROYAL(厚声); Supplier Footprint: 0402; JLCPCB Part Class: Basic Part; Datasheet: https://atta.szlcsc.com/upload/public/pdf/source/20200306/C422600_1E6D84923E4A46A82E41ADD87F860B5C.pdf; Supplier: LCSC; Type: Thick Film Resistors; Tolerance: ±1%; Temperature Coefficient: ±200ppm/℃; Operating Temperature Range: -55℃~+155℃; Standardization Check: false
R45 = RTT025002FTH: LCSC Part Name: 厚膜电阻 50kΩ ±1% 62.5mW; Supplier Part: C166559; Manufacturer: RALEC(旺诠); Supplier Footprint: 0402; JLCPCB Part Class: Extended Part; Datasheet: https://atta.szlcsc.com/upload/public/pdf/source/20180928/C303758_52AE496EA05AD4D633595C32F5A0EBAF.pdf; Supplier: LCSC; Type: Thick Film Resistors; Tolerance: ±1%; Temperature Coefficient: ±100ppm/℃; Operating Temperature Range: -55℃~+155℃; Standardization Check: false
R46 = 0402WGF3833TCE: LCSC Part Name: 383kΩ ±1% 62.5mW 厚膜电阻; Supplier Part: C45993; Manufacturer: UNI-ROYAL(厚声); Supplier Footprint: 0402; JLCPCB Part Class: Extended Part; Datasheet: https://item.szlcsc.com/datasheet/0402WGF3833TCE/46996.html; Supplier: LCSC; Type: Thick Film Resistor; Tolerance: ±1%; Power(Watts): 62.5mW; Voltage-Supply(Max): 50V; Temperature Coefficient: ±100ppm/℃; Operating Temperature: -55℃~+155℃; Standardization Check: false
R47 = 0402WGF2803TCE: LCSC Part Name: 280kΩ ±1% 62.5mW 厚膜电阻; Supplier Part: C46006; Manufacturer: UNI-ROYAL(厚声); Supplier Footprint: 0402; JLCPCB Part Class: Extended Part; Datasheet: https://item.szlcsc.com/datasheet/0402WGF2803TCE/47009.html; Supplier: LCSC; Type: Thick Film Resistor; Tolerance: ±1%; Power(Watts): 62.5mW; Voltage-Supply(Max): 50V; Temperature Coefficient: ±100ppm/℃; Operating Temperature: -55℃~+155℃; Standardization Check: false
R48 = 0402WGF4022TCE: LCSC Part Name: 40.2kΩ ±1% 62.5mW 厚膜电阻; Supplier Part: C25893; Manufacturer: UNI-ROYAL(厚声); Supplier Footprint: 0402; JLCPCB Part Class: Extended Part; Datasheet: https://item.szlcsc.com/datasheet/0402WGF4022TCE/26636.html; Supplier: LCSC; Type: Thick Film Resistor; Tolerance: ±1%; Power(Watts): 62.5mW; Voltage-Supply(Max): 50V; Temperature Coefficient: ±100ppm/℃; Operating Temperature: -55℃~+155℃; Standardization Check: false
R50 = 0402WGF3483TCE: LCSC Part Name: 348kΩ ±1% 62.5mW 厚膜电阻; Supplier Part: C25780; Manufacturer: UNI-ROYAL(厚声); Supplier Footprint: 0402; JLCPCB Part Class: Extended Part; Datasheet: https://item.szlcsc.com/datasheet/0402WGF3483TCE/26523.html; Supplier: LCSC; Type: Thick Film Resistor; Tolerance: ±1%; Power(Watts): 62.5mW; Voltage-Supply(Max): 50V; Temperature Coefficient: ±100ppm/℃; Operating Temperature: -55℃~+155℃; Standardization Check: false
R51 = RC0402FR-07137KL: LCSC Part Name: 厚膜电阻 137kΩ ±1% 62.5mW; Supplier Part: C138058; Manufacturer: YAGEO(国巨); Supplier Footprint: 0402; JLCPCB Part Class: Extended Part; Datasheet: https://item.szlcsc.com/datasheet/RC0402FR-07137KL/149374.html; Supplier: LCSC; Type: Thick Film Resistor; Tolerance: ±1%; Power(Watts): 62.5mW; Voltage-Supply(Max): 50V; Temperature Coefficient: ±100ppm/℃; Operating Temperature: -55℃~+155℃; Standardization Check: false
R52 = RC0402FR-0730KL: LCSC Part Name: 厚膜电阻 30kΩ ±1% 62.5mW; Supplier Part: C138008; Manufacturer: YAGEO(国巨); Supplier Footprint: 0402; JLCPCB Part Class: Extended Part; Datasheet: https://atta.szlcsc.com/upload/public/pdf/source/20250610/89E4D743C004A82A45145C7A2CC3A578.pdf; Supplier: LCSC; Type: Thick Film Resistor; Tolerance: ±1%; Power(Watts): 62.5mW; Voltage-Supply(Max): 50V; Temperature Coefficient: ±100ppm/℃; Operating Temperature: -55℃~+155℃; Standardization Check: false
R53 = 0402WGF2493TCE: LCSC Part Name: 249kΩ ±1% 62.5mW 厚膜电阻; Supplier Part: C11425; Manufacturer: UNI-ROYAL(厚声); Supplier Footprint: 0402; JLCPCB Part Class: Extended Part; Datasheet: https://item.szlcsc.com/datasheet/0402WGF2493TCE/11979.html; Supplier: LCSC; Type: Thick Film Resistor; Tolerance: ±1%; Power(Watts): 62.5mW; Voltage-Supply(Max): 50V; Temperature Coefficient: ±100ppm/℃; Operating Temperature: -55℃~+155℃; Standardization Check: false
U13 = LM5145RGYR: LCSC Part Name: 6V至75V同步降压控制器; Supplier Part: C485912; Manufacturer: TI(德州仪器); Supplier Footprint: VQFN-20-EP(3.5x4.5); JLCPCB Part Class: Extended Part; Datasheet: https://www.ti.com/cn/lit/gpn/lm5145; Supplier: LCSC; Function: Step-down type; Voltage - Supply: 6V~75V; Frequency - Switching: 1MHz; Operating Temperature: -40℃~+125℃@(TJ); Synchronous Rectifier: Yes; Number of Outputs: 1; Topology: Step-down; Switch tube (built-in/external): External
U14 = CRCW06032R10FKEA: LCSC Part Name: 厚膜电阻 2.1Ω ±1% 100mW; Supplier Part: C2077006; Manufacturer: VISHAY(威世); Supplier Footprint: 0603; JLCPCB Part Class: Extended Part; Datasheet: https://atta.szlcsc.com/upload/public/pdf/source/20210503/4CAD3FA9B4C9A749933C1C52DBF827C2.pdf; Supplier: LCSC; Type: Thick Film Resistor; Tolerance: ±1%; Power(Watts): 100mW; Voltage-Supply(Max): 100V; Temperature Coefficient: ±100ppm/℃; Operating Temperature: -55℃~+155℃
U15 U16 U18 = WJ500V-5.08-2P: LCSC Part Name: 1x2P 5.08mm 直插 排数:1 每排P数:2; Supplier Part: C8465; Manufacturer: KANGNEX(康奈克斯电气); Supplier Footprint: 插件,P=5.08mm; JLCPCB Part Class: Extended Part; Datasheet: https://atta.szlcsc.com/upload/public/pdf/source/20191225/C8465_02D34CE5B5B4A53DF5891601D97FA9F4.pdf; Supplier: LCSC; Structure: 1x2P; Pitch: 5.08mm; Color: Green; Mounting Style: Direct Insert; Current Rating (Max): 18A; Voltage Rating (Max): 250V; Number of Pins: 2P; Number of Rows: 1; Wire Gauge - AWG: 14~30; Wire Gauge - mm2: 2.5; Number of PINs Per Row: 2; Operating Temperature Range: -40℃~+105℃; Screw Specification: M2.5
U17 = LMR51430XDDCR: Supplier Part: C5185863; Manufacturer: TI(德州仪器); Supplier Footprint: SOT-23-6; JLCPCB Part Class: Extended Part; Datasheet: https://atta.szlcsc.com/upload/public/pdf/source/20230921/08B58E2AF399A3B97C2B554B7DCF8130.pdf; Supplier: LCSC; Function: Buck; Output Type: Adjustable; Voltage - Supply: 4.5V~36V; Output Voltage: 600mV~34.2V; Output Current: 3A; Frequency - Switching: 500kHz; Operating Temperature: -40℃~+150℃@(TJ); Synchronous Rectifier: Yes; Number of Outputs: 1; Topology: Buck; Switch tube (built-in/external): Built-in
U19 = BQ25713RSNR: LCSC Part Name: 具有系统功率监控器和处理器热量监控器的I²C窄电压直流充电 (NVDC)降压/升压电池充电控制器; Supplier Part: C2878935; Manufacturer: TI(德州仪器); Supplier Footprint: QFN-32-EP(4x4); JLCPCB Part Class: Extended Part; Datasheet: https://www.ti.com/cn/lit/gpn/bq25713b; Supplier: LCSC; The Chip Type: Charging IC; Voltage - Supply: 3.5V~24V; Charge Current - Max: 4.2A; Charging Saturation Voltage: 16.8V; End-Off Voltage: 2.4V; Type of Battery: Lithium-ion/Polymer; Number of Cells: 1~4; Operating Temperature: -40℃~+85℃; Battery Temperature Detection: Not Supported; 0V Battery Charge: Support; Supply Current (Iq): 22uA
U20 = TPS25751DREFR_C30169739: Supplier Part: C30169739; Manufacturer: TI(德州仪器); JLCPCB Part Class: Extended Part; Supplier: LCSC
USB1 = TYPE-C 16PIN 2MD(073): Connector Type:Type-C Protocol Standard:USB 3.1 Gender:Female Mounting Type:Surface Mount, Right Angle Number of Contacts:16P Number of Ports:1 Current Rating-Power:3A Voltage Rating:5V Connect-Disconnect Life:5,000 Cycles Supplementary Features:- Center; LCSC Part Name: Type-C 母 卧贴; Supplier Part: C2765186; Manufacturer: SHOU HAN(首韩); Supplier Footprint: SMD; JLCPCB Part Class: Extended Part; Datasheet: https://item.szlcsc.com/datasheet/TYPE-C%252016PIN%25202MD(073)/2901843.html; Supplier: LCSC; Connector Type: Type-C; Protocol Standard: USB 3.1; Gender: Female; Mounting Type: Surface Mount, Right Angle; Number of Contacts: 16P; Number of Ports: 1; Current Rating-Power: 3A; Voltage Rating: 5V; Connect-Disconnect Life: 5,000 Cycles; Detection color: Black; Operating Temperature: -25℃~+85℃

## Nets
5V_COMP: C56.1 C57.1 U13.4(COMP)
5V_FB: C53.2 C57.2 R18.1 R23.2 R24.2 U13.5(FB)
5V_VCC: C55.2 R20.1 R21.1 U13.14(VCC)
+5V: C51.2 C52.2 C106.1 C107.1 C108.1 C109.1 L4.2 R18.2 R19.2 U18.1 U20.34(PP5V) ; also on sheet 1 3
AGND: C63.2 C64.2 C65.2 C66.2 C67.2 C68.2 C70.2 C71.2 C72.2 C73.2 C74.2 C75.2 C76.2 C80.2 C85.2 Q10.1(S) Q10.2(S) Q10.3(S) Q11.1(S) Q11.2(S) Q11.3(S) R41.2 U16.2 U19.27(PGND)
GND: C47.1 C48.1 C50.1 C51.1 C52.1 C54.1 C55.1 C59.2 C60.2 C61.2 C62.2 C69.2 C81.1 C82.1 C83.1 C84.2 C86.2 C87.2 C88.2 C89.2 C90.2 C91.2 C92.2 C93.2 C94.2 C95.2 C96.2 C97.2 C98.2 C99.2 C100.2 C101.2 C102.2 C103.2 C104.2 C105.2 C106.2 C107.2 C108.2 C109.2 D2.8(GND) D2.13(GND) D2.18(GND) Q2.1(S) Q2.2(S) Q2.3(S) Q5.2(S) Q6.2(S) R16.1 R17.1 R23.1 R30.1 R41.1 R47.2 R51.2 R52.2 R53.1 U13.6(AGND) U13.12(PGND) U15.2 U17.1(GND) U18.2 U19.14(CMPIN) U20.11(GND) U20.12(GND) U20.14(GND) U20.39(GND) USB1.1(GND) USB1.12(GND) USB1.13(SHELL) USB1.14(SHELL) ; also on sheet 1 3 4
VBUS: C101.1 C102.1 C103.1 C104.1 C105.1 U20.24(VBUS_IN) U20.31(GND) U20.32(VBUS) USB1.2(VBUS) USB1.11(VBUS)
VCC: C60.1 C61.1 C69.1 C87.1 D2.10(VPWR) L5.2 Q3.3(D) Q4.3(D) R27.2 R31.1 R38.2 R39.2 R40.2 R45.2 U15.1 U20.38(VIN_3V3) ; also on sheet 1 3 4
VDDA_BAT: C90.1 R44.2 R46.2 R50.2 U19.7(VDDA)
BAT: C79.1 R33.2 R43.2 U16.1 ; also on sheet 3
CHRG_OK: R38.1 U19.4(CHRG_OK) ; also on sheet 1
CMPOUT: R40.1 U19.15(CMPOUT) ; also on sheet 1
DRAIN: U20.15(DRAIN) U20.30(DRAIN) U20.40(DRAIN)
EN_OTG: R39.1 U19.5(OTG/VAP) ; also on sheet 1
PD_CC1: C91.1 D2.12(CC1) U20.28(CC1)
PD_CC2: C89.1 D2.11(CC2) U20.29(CC2)
PD_GP1: Q3.1(G) Q4.1(G)
PD_GP2: Q5.1(G) Q6.1(G)
PD_IRQ: U20.18(I2Cc_IRQ#) ; also on sheet 1
PD_SBU1: D2.15(SBU1) R25.1 R28.2 U20.26(GPIO4/USB_P/LD1)
PD_SBU2: D2.14(SBU2) R26.1 R29.2 U20.27(GPIO5/USB_N/LD2)
PD_SCL: U19.13(SCL) U20.17(I2Cc_SCL)
PD_SDA: U19.12(SDA) U20.16(I2Cc_SDA)
PPHV: C70.1 C71.1 C72.1 C73.1 C74.1 C75.1 C98.1 C99.1 C100.1 R32.1 R34.1 R35.2 R36.2 U20.21(PPHV)
REGN: C85.1 R44.1 U19.28(REGN)
SPU_PD_IRQ: U20.10(I2Ct_IRQ#) ; also on sheet 1
SPU_PD_SCL: U20.9(I2Ct_SCL) ; also on sheet 1
SPU_PD_SDA: U20.8(I2Ct_SDA) ; also on sheet 1
SPU_PROCHOT: R45.1 U19.11(PROCHOT#) ; also on sheet 1
USB_CC1: D2.4(C_CC1) D2.7(RPD_G1) USB1.4(CC1)
USB_CC2: D2.5(C_CC2) D2.6(RPD_G2) USB1.10(CC2)
USB_DN: D2.20(D1) USB1.5(DN2) USB1.7(DN1) ; also on sheet 3
USB_DP: D2.19(D2) USB1.6(DP1) USB1.8(DP2) ; also on sheet 3
USB_SBU1: D2.1(C_SBU1) USB1.9(SBU1)
USB_SBU2: D2.2(C_SBU2) USB1.3(SBU2)
VSYS: C47.2 C59.1 C63.1 C64.1 C65.1 C66.1 C67.1 C68.1 Q8.5(D) Q8.6(D) Q8.7(D) Q8.8(D) Q8.9(D) Q9.5(S) Q9.6(S) Q9.7(S) Q9.8(S) Q9.9(S) R15.2 U14.2 U17.3(VIN) U17.5(EN) U19.22(VSYS)
$2N3293: D2.9(FLT#) R31.2
$2N3500: C62.1 D2.3(VBIAS)
$2N3865: Q5.3(D) R28.1
$2N3867: Q6.3(D) R29.1
$2N3869: Q3.2(S) R25.2
$2N3871: Q4.2(S) R26.2
$2N4534: C86.1 U20.1(LDO_3V3) U20.2(ADCIN1)
$2N4632: C88.1 U20.3(ADCIN2) U20.4(LDO_1V5)
$2N6524: C96.1 R48.1
$2N6614: C97.1 R49.1
$2N6618: C92.1 R48.2 U19.16(COMP1)
$2N6648: C93.1 R49.2 U19.17(COMP2)
$2N6713: R52.1 U19.10(PSYS)
$2N6978: C95.1 U19.9(IBAT)
$2N7041: C94.1 R51.1 U19.8(IADPT)
$2N7165: R46.1 R47.1 U19.6(ILIM_HIZ)
$2N7490: C80.1 R34.2
$2N8943: C83.2 R35.1 U19.1(VBUS)
$2N9020: C81.2 R36.1 U19.3(ACP)
$2N9095: C76.1 Q7.5(D) Q7.6(D) Q7.7(D) Q7.8(D) Q7.9(D) R32.2 R37.2
$2N9137: C82.2 R37.1 U19.2(ACN)
$2N10434: Q7.4(G) U19.31(HIDRV1)
$2N10662: Q10.4(G) U19.29(LODRV1)
$2N10669: C77.2 L6.1 Q7.1(S) Q7.2(S) Q7.3(S) Q10.5(D) Q10.6(D) Q10.7(D) Q10.8(D) Q10.9(D) U19.32(SW1)
$2N10738: C77.1 U19.30(BTST1)
$2N10858: C78.1 U19.25(BTST2)
$2N10868: C78.2 L6.2 Q8.1(S) Q8.2(S) Q8.3(S) Q11.5(D) Q11.6(D) Q11.7(D) Q11.8(D) Q11.9(D) U19.23(SW2)
$2N10954: Q11.4(G) U19.26(LODRV2)
$2N11170: Q8.4(G) U19.24(HIDRV2)
$2N11948: C79.2 C84.1 Q9.1(D) Q9.2(D) Q9.3(D) R33.1 R42.2
$2N11970: Q9.4(G) U19.21(BATDRV#)
$2N11975: R42.1 U19.20(SRP)
$2N11980: R43.1 U19.19(SRN)
$2N13081: C58.2 L5.1 U17.2(SW)
$2N13097: C58.1 U17.6(CB)
$2N13288: R27.1 R30.2 U17.4(FB)
$2N22650: R50.1 R53.2 U19.18(CELL_BATPRESZ)
$2N34168: R15.1 R16.2 U13.1(EN/UVLO)
$2N34212: R20.2 U13.8(SYNCIN)
$2N34217: R21.2 U13.10(PGOOD)
$2N34232: C48.2 U13.3(SS/TRK)
$2N34237: R17.2 U13.2(RT)
$2N34482: C49.2 U13.17(BST)
$2N34623: Q1.4(G) U13.18(HO)
$2N34654: C50.2 Q1.5(D) Q1.6(D) Q1.7(D) Q1.8(D) U13.20(VIN) U14.1
$2N34904: C54.2 R22.1 U13.11(ILIM)
$2N35129: C49.1 L4.1 Q1.1(S) Q1.2(S) Q1.3(S) Q2.5(D) Q2.6(D) Q2.7(D) Q2.8(D) Q2.9(D) R22.2 U13.19(SW)
$2N35132: Q2.4(G) U13.13(LO)
$2N35591: C56.2 R24.1
$2N35748: C53.1 R19.1

Not connected (* = marked no-connect by the designer): D2 16(N.C.)* 17(N.C.)* 21(EP)*; U13 7(SYNCOUT)* 9(NC)* 15(EP)* 16(NC)* 21(EP)*; U19 33(EP)*; U20 5(GPIO0)* 6(GPIO1)* 7(GPIO2)* 13(GPIO11)* 19(GPIO3)* 36(GPIO7)* 37(GPIO6)*

## Notes on the sheets
sheet 2
- USB-C
- 5V BUCK
- USB ESD
- 3V3 BUCK
- TERMINALS
- USB POWER DELIVERY
- BATTERY CHARGER
